# EasyEDA Pro project Dart25-有控镖航电系统.eprj, board PCB1
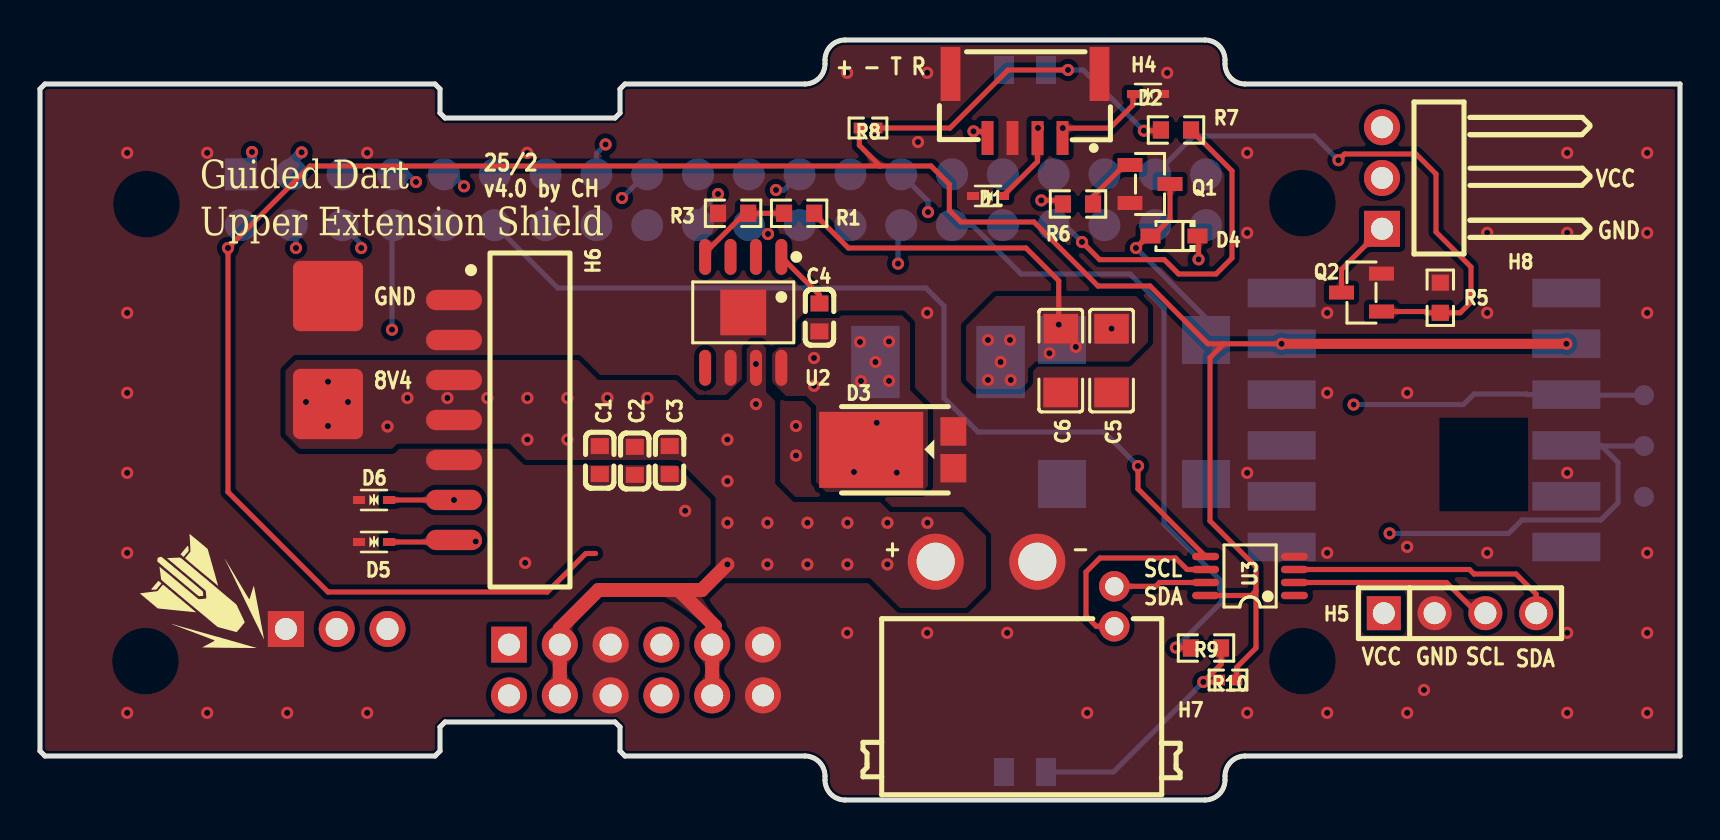
[diagram p6: board, top side]
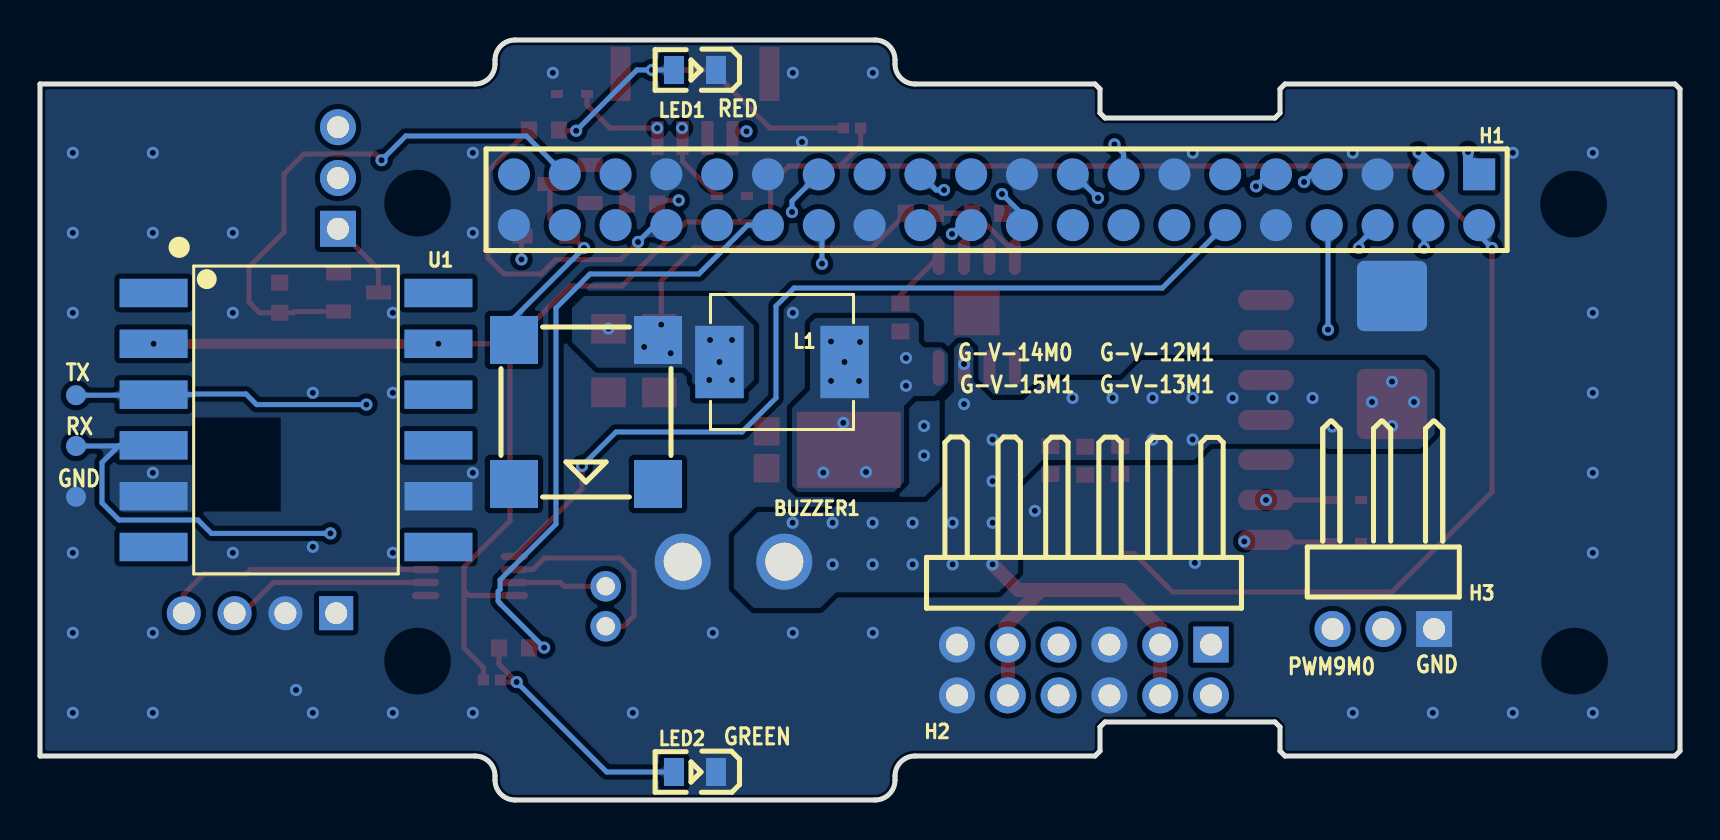
[diagram p7: board, bottom side, seen from below]

Outline 82 x 38 mm; copper layers: Top Layer, Inner1, Inner2, Bottom Layer. Coordinates in mm from the lower left corner of the outline.
Outline path: 0,35.55 0.25,35.8 19.75,35.8 20,35.55 20,34.35 20.25,34.1 28.75,34.1 29,34.35 29,35.55 29.25,35.8 38.25,35.8 arc(38.96,36.09) 39.25,36.8 39.25,37 arc(39.54,37.71) 40.25,38 58.25,38 arc(58.96,37.71) 59.25,37 59.25,36.8 arc(59.54,36.09) 60.25,35.8 82,35.8 82,2.2 60.25,2.2 arc(59.54,1.91) 59.25,1.2 59.25,1 arc(58.96,0.29) 58.25,0 40.25,0 arc(39.54,0.29) 39.25,1 39.25,1.2 arc(38.96,1.91) 38.25,2.2 29.25,2.2 29,2.45 29,3.65 28.75,3.9 20.25,3.9 20,3.65 20,2.45 19.75,2.2 0.25,2.2 0,2.45 0,35.55
Stack: Top Layer 0.035mm 外层铜厚1oz / Dielectric1 0.2104mm 7628 RC49% 8.6mil / Inner1 0.0152mm 内层铜厚 / Dielectric2 1.065mm 1.1mm H/HOZ Copper / Inner2 0.0152mm 内层铜厚 / Dielectric3 0.2104mm 7628 RC49% 8.6mil / Bottom Layer 0.035mm 外层铜厚1oz

## Design rules (mm)
template: 自定义配置
spacing copperThickness1oz (default): track to track 0.102, other pairs 0.152 to 0.3
spacing copperThickness2oz: track to track 0.203, other pairs 0.152 to 0.3
track width copperThickness1oz (default): min 0.127, default 0.254, max 2.54
track width copperThickness2oz: min 0.203, default 0.254, max 2.54
differential pair differentialPair (default): width min 0.127, default 0.254, max 2.54; gap min 0.152, default 0.152
via viaSize (default): diameter min 0.5, default 0.61, max 10; hole min 0.3, default 0.305, max 6.3
net GND uses copperRegion_Power
net VBUS_SOC uses copperRegion_Power
net $1N16519 uses copperRegion_Power
net VCC_8V4 uses copperRegion_Power
pour e255 uses copperRegion_Power
pour e47 uses copperRegion_Power

## Placement (name value [footprint] x y rotation side)
BUZZER1  2.7kHz  [BUZ-SMD_4P-L8.5-W8.5-P8.50-BR]  54.7 19.4 0 bottom
C1  4.7uF  [C0603]  27.99 17 90 top
C2  100nF  [C0603]  29.74 16.96 90 top
C3  4.7uF  [C0603]  31.48 17 90 top
C4  10nF  [C0603]  38.97 24.13 270 top
C5  100uF  [C1206]  53.58 21.97 90 top
C6  100uF  [C1206]  51.04 21.97 90 top
D1  PESD3V3S1BA-N  [SOD-523_L1.2-W0.8-LS1.6-BI]  47.4 30.2 180 top
D2  PESD3V3S1BA-N  [SOD-523_L1.2-W0.8-LS1.6-BI]  55.4 35.3 180 top
D3  SB1045L  [TO-277_3P-L5.4-W4.0-LS6.5-TR]  43.61 17.51 0 top
D4  1N4148WS  [SOD-323_L1.8-W1.3-LS2.5-RD]  56.7 28.2 180 top
D5  PESD3V3S1BA-N  [SOD-523_L1.2-W0.8-LS1.6-BI]  16.7 12.9 180 top
D6  PESD3V3S1BA-N  [SOD-523_L1.2-W0.8-LS1.6-BI]  16.7 15 180 top
H1  2.54-2*20  [HDR-TH_40P-P2.54-V-F-R2-C20-S2.54]  34.17 30.01 0 bottom
H2  PZ254R-12-12P  [HDR-TH_12P-P2.54-H-M-R2-C6-S2.54]  29.8 6.5 0 bottom
H3  PZ254R-11-03P  [HDR-TH_3P-P2.54-H-M-W10.4]  14.83 8.55 0 bottom
H4  SM04B-GHS-TB(LF)(SN)  [CONN-SMD_4P-P1.25_SM04B-GHS-TB-LF-SN]  49.25 34.7 180 top
H5  PZ254V-11-04P  [HDR-TH_4P-P2.54-V-M]  71 9.34 0 top
H6  DS-A11F-C-8P-S2  [CONN-TH_8P-P2.00_DS-A11M-A-7P-R4]  24.5 19 270 top
H7  XT30PW(2+2)-M.G.B  [CONN-TH_4P-XT30PW-M]  49.25 10.3 0 top
H8  PZ254R-11-03P  [HDR-TH_3P-P2.54-H-M-W10.4]  67.1 31.1 90 top
L1  15uH  [IND-SMD_L7.0-W6.6_FXL0630]  44.9 21.9 180 bottom
LED1  NCD0805R1  [LED0805-R-RD]  49.25 36.5 0 bottom
LED2  KT-0805G  [LED0805-R-RD]  49.25 1.4 0 bottom
NOREF  -  [Pad_e45]  14.4 25.2 0 top
NOREF#2  -  [Pad_e67]  80.2 17.7 90 top
NOREF#3  -  [Pad_e36]  14.4 25.2 0 top
NOREF#4  -  [Pad_e43]  14.4 19.8 0 top
NOREF#5  -  [Pad_e68]  80.2 20.24 90 top
NOREF#6  -  [Pad_e66]  80.2 15.16 90 top
Q1  SS8050  [SOT-23-3_L2.9-W1.3-P1.90-LS2.4-BR]  55.5 30.8 180 top
Q2  AO3400A  [SOT-23-3_L2.9-W1.3-P1.90-LS2.4-BR]  66.07 25.37 0 top
R1  10kΩ  [R0603]  37.96 29.34 0 top
R3  3.16kΩ  [R0603]  34.65 29.34 0 top
R5  10kΩ  [R0603]  70.01 25.11 90 top
R6  100Ω  [R0603]  51.9 29.8 0 top
R7  200Ω  [R0603]  56.8 33.5 0 top
R8  470Ω  [R0402]  41.4 33.6 180 top
R9  200Ω  [R0603]  58.3 7.6 180 top
R10  470Ω  [R0402]  59.4 6 0 top
U1  a8ae0a33bb354d2f920b72217bd8033d  [SMT-邮票孔-2.54-12Pin]  69.2 19 270 bottom
U2  TPS5450DDAR  [SOP-8_L4.9-W3.9-P1.27-LS6.0-BL-EP]  35.16 24.38 180 top
U3  PCA9515ADP,118  [TSSOP-8_L3.0-W3.0-P0.65-LS4.9-BL]  60.5 11.2 90 top

## Footprints (pads in the part's own frame, mm; a bottom-side part is the same pattern mirrored in y, then rotated)
BUZ-SMD_4P-L8.5-W8.5-P8.50-BR
  rect 2.4x2.4 smd: 1(-3.6,-3.6) 2(3.6,-3.6) 3(3.599,3.599) 4(-3.6,3.6)
C0603
  rect 0.8x0.9 smd: 1(-0.7,0) 2(0.7,0)
C1206
  rect 1.485x1.728 smd: 1(-1.593,0) 2(1.593,0)
CONN-SMD_4P-P1.25_SM04B-GHS-TB-LF-SN
  rect 0.6x1.7 smd: 1(-1.875,1.599) 2(-0.625,1.599) 3(0.625,1.599) 4(1.875,1.599)
  rect 1x2.7 smd: 5(3.724,-1.599) 6(-3.724,-1.599)
CONN-TH_4P-XT30PW-M
  round 2.8 hole 1.9: 1(-4.465,1.615) 2(0.615,1.615)
  round 1.524 hole 0.914: 3(4.465,0.385) 4(4.465,-1.615)
CONN-TH_8P-P2.00_DS-A11M-A-7P-R4
  oval 1.016x2.794 smd: 1(-5.997,-3.801) 2(-3.998,-3.801) 3(-1.999,-3.801) 4(0,-3.801) 5(1.999,-3.801) 6(3.998,-3.801) 7(5.997,-3.801)
HDR-TH_3P-P2.54-H-M-W10.4
  rect 1.8x1.8 hole 1.1: 1(-2.54,0)
  round 1.8 hole 1.1: 2(0,0) 3(2.54,0)
HDR-TH_4P-P2.54-V-M
  rect 1.7x1.7 hole 1.1: 1(-3.81,0)
  round 1.7 hole 1.1: 2(-1.27,0) 3(1.27,0) 4(3.81,0)
HDR-TH_12P-P2.54-H-M-R2-C6-S2.54
  rect 1.778x1.8 hole 1.1: 1(-6.35,-1.27)
  round 1.8 hole 1.1: 2(-6.35,1.27) 3(-3.81,-1.27) 4(-3.81,1.27) 5(-1.27,-1.27) 6(-1.27,1.27) 7(1.27,-1.27) 8(1.27,1.27) 9(3.81,-1.27) 10(3.81,1.27) 11(6.35,-1.27) 12(6.35,1.27)
HDR-TH_40P-P2.54-V-F-R2-C20-S2.54
  rect 1.6x1.6 smd: 1(-24.13,-1.27)
  round 1.6 smd: 2(-24.13,1.27) 3(-21.59,-1.27) 4(-21.59,1.27) 5(-19.05,-1.27) 6(-19.05,1.27) 7(-16.51,-1.27) 8(-16.51,1.27) 9(-13.97,-1.27) 10(-13.97,1.27) 11(-11.43,-1.27) 12(-11.43,1.27) 13(-8.89,-1.27) 14(-8.89,1.27) 15(-6.35,-1.27) 16(-6.35,1.27) 17(-3.81,-1.27) 18(-3.81,1.27) 19(-1.27,-1.27) 20(-1.27,1.27) 21(1.27,-1.27) 22(1.27,1.27) 23(3.81,-1.27) 24(3.81,1.27) 25(6.35,-1.27) 26(6.35,1.27) 27(8.89,-1.27) 28(8.89,1.27) 29(11.43,-1.27) 30(11.43,1.27) 31(13.97,-1.27) 32(13.97,1.27) 33(16.51,-1.27) 34(16.51,1.27) 35(19.05,-1.27) 36(19.05,1.27) 37(21.59,-1.27) 38(21.59,1.27) 39(24.13,-1.27) 40(24.13,1.27)
IND-SMD_L7.0-W6.6_FXL0630
  rect 2.424x3.62 smd: 1(3.128,0) 2(-3.128,0)
LED0805-R-RD
  rect 1x1.399 smd: 1(1.05,0) 2(-1.05,0)
Pad_e36
  rrect 3.5x3.51 smd: 41(0,0)
Pad_e43
  rrect 3.5x3.51 smd: 42(0,0)
Pad_e45
  rrect 3.5x3.51 smd far side: 41(0,0)
Pad_e66
  round 1 smd far side: 36(0,0)
Pad_e67
  round 1 smd far side: 36(0,0)
Pad_e68
  round 1 smd far side: 37(0,0)
R0402
  rect 0.566x0.54 smd: 1(-0.433,0) 2(0.433,0)
R0603
  rect 0.806x0.864 smd: 1(-0.753,0) 2(0.753,0)
SMT-邮票孔-2.54-12Pin
  rect 1.423x3.401 smd: 1(-6.35,-7.12) 2(-3.81,-7.12) 3(-1.27,-7.12) 4(1.27,-7.12) 5(3.81,-7.12) 6(6.35,-7.12) 7(6.35,7.12) 8(3.81,7.12) 9(1.27,7.12) 10(-1.27,7.12) 11(-3.81,7.12) 12(-6.35,7.12)
SOD-323_L1.8-W1.3-LS2.5-RD
  rect 1x0.75 smd: 1(-1.173,0) 2(1.173,0)
SOD-523_L1.2-W0.8-LS1.6-BI
  rect 0.6x0.4 smd: 1(-0.75,0) 2(0.75,0)
SOP-8_L4.9-W3.9-P1.27-LS6.0-BL-EP
  oval 0.6x1.8 smd: 1(-1.905,-2.772) 2(-0.635,-2.772) 3(0.635,-2.772) 4(1.905,-2.772) 5(1.905,2.772) 6(0.635,2.772) 7(-0.635,2.772) 8(-1.905,2.772)
  rect 2.29x2.29 smd: 9(0,0)
SOT-23-3_L2.9-W1.3-P1.90-LS2.4-BR
  rect 1.25x0.7 smd: 1(1,-0.95) 2(1,0.95) 3(-1,0)
TO-277_3P-L5.4-W4.0-LS6.5-TR
  rect 1.29x1.423 smd: 1(2.054,0.92) 3(2.054,-0.92)
  rect 5.2x3.8 smd: 2(-2.054,0)
TSSOP-8_L3.0-W3.0-P0.65-LS4.9-BL
  oval 0.37x1.35 smd: 1(-0.975,-2.22) 2(-0.325,-2.22) 3(0.325,-2.22) 4(0.975,-2.22) 5(0.975,2.22) 6(0.325,2.22) 7(-0.325,2.22) 8(-0.975,2.22)

## Nets
As in the schematic, except:
GND: C1.1 C2.1 C3.1 C5.1 C6.1 D1.2 D2.1 D3.1 D3.3 D5.2 D6.2 H1.5 H1.10 H1.13 H1.19 H1.26 H1.29 H1.33 H1.40 H2.5 H2.6 H2.11 H2.12 H3.1 H4.3 H4.5 H4.6 H5.2 H6.1 H6.2 H6.5 H7.2 LED1.2 LED2.2 NOREF.41 NOREF#3.41 NOREF#6.36 Q1.2 Q2.2 R3.1 R5.2 U1.5 U1.8 U2.6 U2.9 U3.4
VCC_8V4: C1.2 C2.2 C3.2 H2.3 H2.4 H2.9 H2.10 H6.3 H6.4 H7.1 NOREF#4.42 U2.7
UART3_RX: H1.4 NOREF#2.36 U1.4
UART3_TX: H1.6 NOREF#5.37 U1.3

Pads without a net: BUZZER1 3 4; H1 11 14 16 18 21 24 25 31 32 35 36 38 39; H3 2; H8 3; U1 1 6 7 9 10 12; U2 2 3 5; U3 1

## Via types
v1: diameter 0.61, hole 0.305, Top Layer to Bottom Layer, 133 vias

## Routing (per net, layer and track width the routed paths; a pad name or vN(x,y) marks a point on that pad's centre or on a via; arc(x,y) is an arc through that point)
GND:
  vias: v1(4.36,32.36) v1(4.36,24.36) v1(4.36,20.36) v1(4.36,16.36) v1(4.36,12.36) v1(4.36,4.36) v1(8.36,32.36) v1(8.36,4.36) v1(12.36,4.36) v1(16.36,32.36) v1(16.36,4.36) v1(24.26,11.86) v1(24.36,32.36) v1(32.26,14.46) v1(37.8,18.7) v1(37.8,17.22) v1(40.36,36.36) v1(40.36,8.36) v1(43.9,32.9) v1(44.36,36.36) v1(44.36,24.36) v1(44.36,8.36) v1(48.36,8.36) v1(52.36,4.36) v1(56.36,36.36) v1(60.36,32.36) v1(60.36,28.36) v1(60.36,16.36) v1(60.36,4.36) v1(64.36,24.36) v1(64.36,20.36) v1(64.36,12.36) v1(64.36,4.36) v1(68.36,20.36) v1(68.36,12.66) v1(68.36,4.36) v1(69.2,5.5) v1(72.36,28.36) v1(72.36,24.36) v1(72.36,12.36) v1(76.36,32.36) v1(76.36,28.36) v1(76.36,16.36) v1(76.36,8.36) v1(76.36,4.36) v1(80.36,32.36) v1(80.36,28.36) v1(80.36,24.36) v1(80.36,12.36) v1(80.36,8.36) v1(80.36,4.36)
VBUS_SOC: length 20.5
  Top Layer w0.254: v1(50.94,23.77) 50.94,25.96 49.3,27.6 40.42,27.6 38.71,29.31 R1.2 ; H4.4 47.04,33.43 v1(46.68,33.43) ; v1(57.93,27.03) 57.93,28.14 D4.1
  Bottom Layer w0.5: v1(10.6,32.4) 10.6,31.84 H1.1 ; v1(13.08,32.38) 12.58,31.88 H1.3
  vias: v1(47.4,23) v1(47.4,21) v1(48.03,21.9) v1(48.5,23) v1(48.54,21) v1(50.47,22.34) v1(51.79,22.65) v1(53.58,23.57)
VCC_3V3_SOC: length 131.3
  Top Layer w0.254: 60.8,10.45 60.8,7.6 59.83,6.63 R10.2 ; 60.8,10.45 60.8,11.65 58.5,13.95 58.5,22.12 59.19,22.81 ; 60.8,10.45 60.57,10.23 U3.8 ; R8.2 40.97,32.73 42,31.7 ; v1(62.08,22.81) 59.19,22.81 ; 59.19,22.81 58.39,22.81 55.5,25.7 52.9,25.7 49.7,28.9 46.05,28.9 45.47,29.48 45.47,30.78 44.55,31.7 42,31.7 ; 42,31.7 13.5,31.7 v1(9.4,27.6) 9.4,15.4 14.4,10.4 25.37,10.4 27.29,12.33 27.78,12.33
  Top Layer w0.5: v1(76.32,22.81) v1(62.08,22.81)
  Bottom Layer w0.254: v1(9.4,27.6) 10.04,28.24 H1.2
VCC_8V4: length 19.1
  Top Layer w0.7: 32.08,10.36 32.08,10.5 33.09,10.5 v1(34.37,11.78) ; 32.08,10.36 33.74,8.7 33.61,8.57 H2.10 ; 32.08,10.36 31.94,10.5 27.92,10.5 25.99,8.57 H2.4
  vias: v1(13.3,19.9) v1(14.4,20.92) v1(14.4,18.7) v1(15.4,19.9) v1(17.38,18.68) v1(18.37,20.1) v1(20.37,20.1) v1(22.37,20.1) v1(24.37,20.1) v1(24.37,18.02) v1(26.37,20.1) v1(26.37,18.02) v1(28.37,20.1) v1(30.37,20.1) v1(34.37,18.02) v1(34.37,15.94) v1(34.37,13.86) v1(35.8,21.8) v1(35.8,19.8) v1(36.37,13.86) v1(36.37,11.78) v1(38.37,13.86) v1(38.37,11.78) v1(40.37,13.86) v1(40.37,11.78) v1(42.37,13.86) v1(42.37,11.78) v1(44.37,13.86)
DART_TRIGGER_EN: length 27.7
  Top Layer w0.254: v1(64.92,31.99) 65.23,32.3 68.8,32.3 69.8,31.3 69.8,28.4 71.55,26.65 71.55,24.9 71.01,24.36 R5.1 69.33,24.36 69.26,24.42 Q2.1
  Bottom Layer w0.254: v1(64.92,31.99) 63.71,33.2 57.68,33.2 H1.37
DBG_RX: length 37.4
  Top Layer w0.254: v1(51.14,33.59) 53.5,33.59 54.65,34.75 D2.2
  Inner2 w0.254: v1(51.14,33.59) 51.14,32.74 50.4,32 33.9,32 32.58,30.68 v1(21.2,30.68)
  Bottom Layer w0.254: H1.9 20.6,31.28 v1(21.2,30.68)
DBG_TX: length 38.1
  Top Layer w0.254: D1.1 49.88,31.93 H4.2
  Inner2 w0.254: v1(18.8,30.9) 19.4,31.5 31.7,31.5 35,34.8 48.7,34.8 v1(49.9,33.6)
  Bottom Layer w0.254: v1(18.8,30.9) 18.42,31.28 H1.7
I2C_EN: length 45.8
  Top Layer w0.254: U3.5 54.9,15.56 v1(54.9,16.7)
  Bottom Layer w0.254: H1.12 25.88,25.6 44.3,25.6 45.2,24.7 45.2,20.1 46.9,18.4 53.2,18.4 v1(54.9,16.7)
LED_GREEN: length 32.2
  Top Layer w0.254: v1(56.79,7.62) 57.53,7.62 R9.2
  Bottom Layer w0.254: H1.30 46.62,28.74 49.06,26.3 54.5,26.3 56.2,24.6 56.2,13.8 58.99,11.01 58.99,10.53 59.09,10.43 59.09,9.94 58.99,9.84 58.99,9.82 v1(56.79,7.62)
LED_RED: length 17.5
  Top Layer w0.254: R7.2 59.6,31.45 59.6,27.1 58.8,26.3 56.93,26.3 56.22,27.02 52.98,27.02 v1(52.1,27.9)
  Bottom Layer w0.254: v1(52.1,27.9) 51.26,28.74 H1.34
PWM8M0: length 26.1
  Top Layer w0.254: R6.1 50.97,29.98 v1(50.06,29.98)
  Inner1 w0.254: v1(50.06,29.98) 42.82,29.98 39.7,33.1 28.6,33.1 v1(28.28,32.78)
  Bottom Layer w0.254: H1.15 27.82,32.32 v1(28.28,32.78)
PWM9M0: length 56.2
  Inner1 w0.254: H3.3 15.12,6.3 10.7,6.3 5.7,11.3 5.7,26 9.8,30.1 v1(29.1,30.1)
  Bottom Layer w0.254: v1(29.1,30.1) 30.28,31.28 H1.17
PWM12M1: length 55.1
  Inner1 w0.254: 23.45,8.57 23.05,8.57 19.82,11.8 11.4,11.8 9.7,13.5 9.7,22.6 11.4,24.3 32.4,24.3 v1(36.4,28.3)
  Bottom Layer w0.254: v1(36.4,28.3) 35.96,28.74 H1.22
PWM13M1: length 62.6
  Inner1 w0.254: v1(36.8,30.5) 33.2,26.9 10.3,26.9 8.1,24.7 8.1,13.4 11,10.5 17.9,10.5 23.17,5.23 H2.2
  Bottom Layer w0.254: H1.23 37.2,30.5 v1(36.8,30.5)
PWM14M0: length 40.5
  Inner1 w0.254: 31.07,8.57 23.44,16.2 12.5,16.2 10.9,17.8 10.9,21.6 12.82,23.52 v1(17.6,23.52)
  Bottom Layer w0.254: H1.8 17.6,28.68 v1(17.6,23.52)
PWM15M1: length 60.3
  Inner1 w0.254: v1(33.9,30.3) 33.9,30.9 35.1,32.1 38.6,32.1 39.8,30.9 39.8,27.4 52,15.2 52,10.1 45.1,3.2 33.9,3.2 31.07,6.03
  Bottom Layer w0.254: H1.20 32.9,29.3 v1(33.9,30.3)
SCL: length 43.3
  Top Layer w0.254: v1(21.79,12.93) 20.77,12.93 H6.7 20.6,12.9 D5.1 ; H7.3 55.78,10.69 55.97,10.88 U3.7
  Inner2 w0.254: H7.3 53.72,10.48 52.43,9.2 29.7,9.2 26.07,12.83 21.89,12.83 v1(21.79,12.93)
SCL_LOCAL: length 53.2
  Top Layer w0.254: H5.3 71.86,9.34 70.32,10.88 U3.2
  Inner2 w0.254: v1(44.4,29.4) 44.4,29 48.4,25 62.89,25 69.1,18.79 69.1,11.73 69.4,11.43 70.18,11.43 H5.3
  Bottom Layer w0.254: H1.27 44.4,29.94 v1(44.4,29.4)
SDA: length 59
  Top Layer w0.254: U3.6 57.35,11.53 56.78,12.1 53,12.1 52.3,11.4 52.3,9.2 52.81,8.69 H7.4 ; D6.1 v1(20.7,15)
  Inner2 w0.254: H7.4 49.03,4 30.3,4 29.71,4.59 29.71,5.72 29.02,6.41 28.04,6.41 28.03,6.4 26.49,6.4 26.48,6.41 25.5,6.41 25.49,6.4 23.95,6.4 23.94,6.41 22.96,6.41 22.95,6.4 20.75,6.4 20.5,6.65 20.5,14.8 v1(20.7,15)
SDA_LOCAL: length 67.4
  Top Layer w0.254: H5.4 74.81,10.29 73.8,11.3 71.7,11.3 71.47,11.53 U3.3
  Inner2 w0.254: v1(42.9,26.82) 42.9,30.2 43.8,31.1 44.93,31.1 50.03,26 69,26 75.77,19.23 75.77,10.3 H5.4
  Bottom Layer w0.254: H1.28 42.9,28.58 v1(42.9,26.82)
UART3_RX: length 82.6
  Inner2 w0.254: v1(67.48,13.33) 50.82,13.33 46.55,17.6 41.3,17.6 39.6,19.3 39.6,22.1 36.1,25.6 14.8,25.6 v1(12.8,27.6)
  Bottom Layer w0.254: H1.4 12.8,28.52 v1(12.8,27.6) ; 78.07,17.7 78.04,17.73 U1.4 ; 78.07,17.7 NOREF#2.36 ; 78.07,17.7 78.9,16.88 78.9,14.86 78.04,14 74.1,14 73.43,13.33 v1(67.48,13.33)
UART3_TX: length 69.8
  Inner2 w0.254: v1(65.68,19.77) 64.6,19.77 64.6,19.77 64.12,19.77 63.62,20.27 46.53,20.27 44.2,22.6 44.2,23.69 40.49,27.4 16.26,27.4 v1(16.06,27.6)
  Bottom Layer w0.254: v1(16.06,27.6) 16.06,27.81 H1.6 ; v1(65.68,19.77) 71.17,19.77 71.7,20.3 74.34,20.3 74.37,20.27 U1.3 76.35,20.24 NOREF#5.37
$1N13997: length 10.1
  Top Layer w0.254: v1(54.8,27.6) 55.4,28.2 D4.2 55.65,28.2 56.5,29.05 Q1.3
  Bottom Layer w0.254: v1(54.8,27.6) 58.3,24.1 BUZZER1.2
$1N14165: length 2.9
  Top Layer w0.254: R6.2 52.65,30.18 54.22,31.75 Q1.1
$1N15608: length 4
  Top Layer w0.254: Q2.3 65.07,26.53 H8.1
$1N15893: length 3.1
  Top Layer w0.254: C4.1 38.97,25.25 U2.1
$1N16519:
  vias: v1(38.7,22.1) v1(38.7,20.71) v1(40.7,16.4) v1(41,22.9) v1(41.05,20.95) v1(41.77,21.9) v1(41.84,18.86) v1(42.45,22.92) v1(42.45,20.95) v1(42.84,16.37)
$1N16862: length 5
  Top Layer w0.254: U2.4 33.26,27.36 35.24,29.34 R3.2 R1.1
$1N27387: length 12.6
  Top Layer w0.254: R9.1 59.05,6.79 v1(58.17,5.9) 58.87,5.9 R10.1
  Bottom Layer w0.254: LED2.1 53.67,1.4 v1(58.17,5.9)
$1N27447: length 17.8
  Top Layer w0.254: R7.1 56.01,33.46 v1(55.19,33.46) ; v1(51.4,36.5) 48.4,36.5 45.5,33.6 R8.1
  Bottom Layer w0.254: v1(55.19,33.46) 52.16,36.5 v1(51.4,36.5) LED1.1

## Copper pours and planes (outline as drawn; the poured copper is in the pictures)
GND on Top Layer: -2.3,40 83.7,40 83.7,-7.3 -2.3,-7.3
GND on Top Layer: -2.3,40.01 83.7,40.01 83.7,-7.29 -2.3,-7.29
GND on Bottom Layer: -2.4,39.9 85.3,39.9 85.3,-6.7 -2.4,-6.7
GND on Inner2: -2.3,40 83.7,40 83.7,-7.3 -2.3,-7.3
VBUS_SOC on Top Layer: 46.3,25.2 55.4,25.2 55.4,20.55 46.3,20.55
VBUS_SOC on Bottom Layer: 46.3,25.2 55.4,25.2 55.4,20.55 46.3,20.55
VBUS_SOC on Inner1: -2.3,40 83.7,40 83.7,-7.3 -2.3,-7.3
VCC_8V4 on Top Layer: 12.8,22 12.27,21.47 12.27,18.29 13,17.56 17.61,17.56 17.86,17.81 23.49,17.81 24.3,17 31.9,17 33.78,15.12 33.78,11.49 34.18,11.09 41.51,11.09 43,9.6 46.3,9.6 47.3,10.6 47.3,13.2 46.1,14.4 42.5,14.4 42,14.9 37.67,14.9 36.75,15.81 36.75,19.95 36.3,20.4 36.3,22.6 36.04,22.86 35.63,22.86 35.34,22.56 35.34,20.94 34.4,20 32.8,20 31.8,21 27.9,21 26.9,22
VCC_8V4 on Bottom Layer: 12.8,22 12.27,21.47 12.27,18.29 13,17.56 17.61,17.56 17.86,17.81 23.49,17.81 24.3,17 31.9,17 33.1,15.8 33.1,11.37 34.08,10.39 42.21,10.39 43,9.6 46.3,9.6 47.3,10.6 47.3,13.2 46.1,14.4 42.5,14.4 42,14.9 37.67,14.9 36.75,15.81 36.75,19.95 36.3,20.4 36.3,22.6 36.04,22.86 35.63,22.86 35.34,22.56 35.34,20.94 34.4,20 32.8,20 31.8,21 27.9,21 26.9,22
VCC_8V4 on Bottom Layer: 12.8,22 12.27,21.47 12.27,18.29 13,17.56 17.61,17.56 17.86,17.81 23.49,17.81 24.3,17 31.9,17 33.1,15.8 33.1,11.37 34.08,10.39 42.21,10.39 43,9.6 46.3,9.6 47.3,10.6 47.3,13.2 46.1,14.4 42.5,14.4 42,14.9 37.67,14.9 36.75,15.81 36.75,19.95 36.3,20.4 36.3,22.6 36.04,22.86 35.63,22.86 35.34,22.56 35.34,20.94 34.4,20 32.8,20 31.8,21 27.9,21 26.9,22
VCC_8V4 on Inner1: 12.8,22 12.27,21.47 12.27,18.29 13,17.56 17.61,17.56 17.86,17.81 23.49,17.81 24.3,17 31.9,17 33.1,15.8 33.1,11.37 34.08,10.39 42.21,10.39 43,9.6 46.3,9.6 47.3,10.6 47.3,13.2 46.1,14.4 42.5,14.4 42,14.9 37.67,14.9 36.75,15.81 36.75,19.95 36.3,20.4 36.3,22.6 36.04,22.86 35.63,22.86 35.34,22.56 35.34,20.94 34.4,20 32.8,20 31.8,21 27.9,21 26.9,22
VCC_8V4 on Inner2: 12.8,22 12.27,21.47 12.27,18.29 13,17.56 17.61,17.56 17.86,17.81 23.49,17.81 24.3,17 31.9,17 33.1,15.8 33.1,13.47 35.48,11.09 42.41,11.09 42.9,10.6 46.1,10.6 46.7,11.2 46.7,13.4 45.7,14.4 42.5,14.4 42,14.9 37.67,14.9 36.75,15.81 36.75,19.95 36.3,20.4 36.3,22.6 36.04,22.86 35.63,22.86 35.34,22.56 35.34,20.94 34.4,20 32.8,20 31.8,21 27.9,21 26.9,22
$1N16519 on Top Layer: 36.6,24.23 44.4,24.23 44.4,15.4 36.6,15.4
$1N16519 on Bottom Layer: 38.31,24.1 38.06,23.85 38.06,22.88 37.81,22.63 36.93,22.63 36.6,22.3 36.6,20.9 37.3,20.2 38.3,20.2 38.8,19.7 38.8,15.9 39.3,15.4 44.1,15.4 44.4,15.7 44.4,19.6 43.5,20.5 43.5,23.83 43.23,24.1

Small or netless copper shapes (teardrops, artwork), in the pictures only: 75 on Top Layer, 54 on Bottom Layer, 12 on Inner1, 16 on Inner2

## Text on the board
Bottom Silkscreen Layer: GREEN | RED | TX | RX | GND | PWM9M0 | G-V-12M1 | G-V-13M1 | G-V-15M1 | G-V-14M0
Top Silkscreen Layer: GND | 8V4 | 25/2 / v4.0 by CH | + | - | SCL | SDA | VCC | + - T R | Guided Dart / Upper Extension Shield
